# EAGLE design A6ECU-5 (EAGLE 7.5.0)
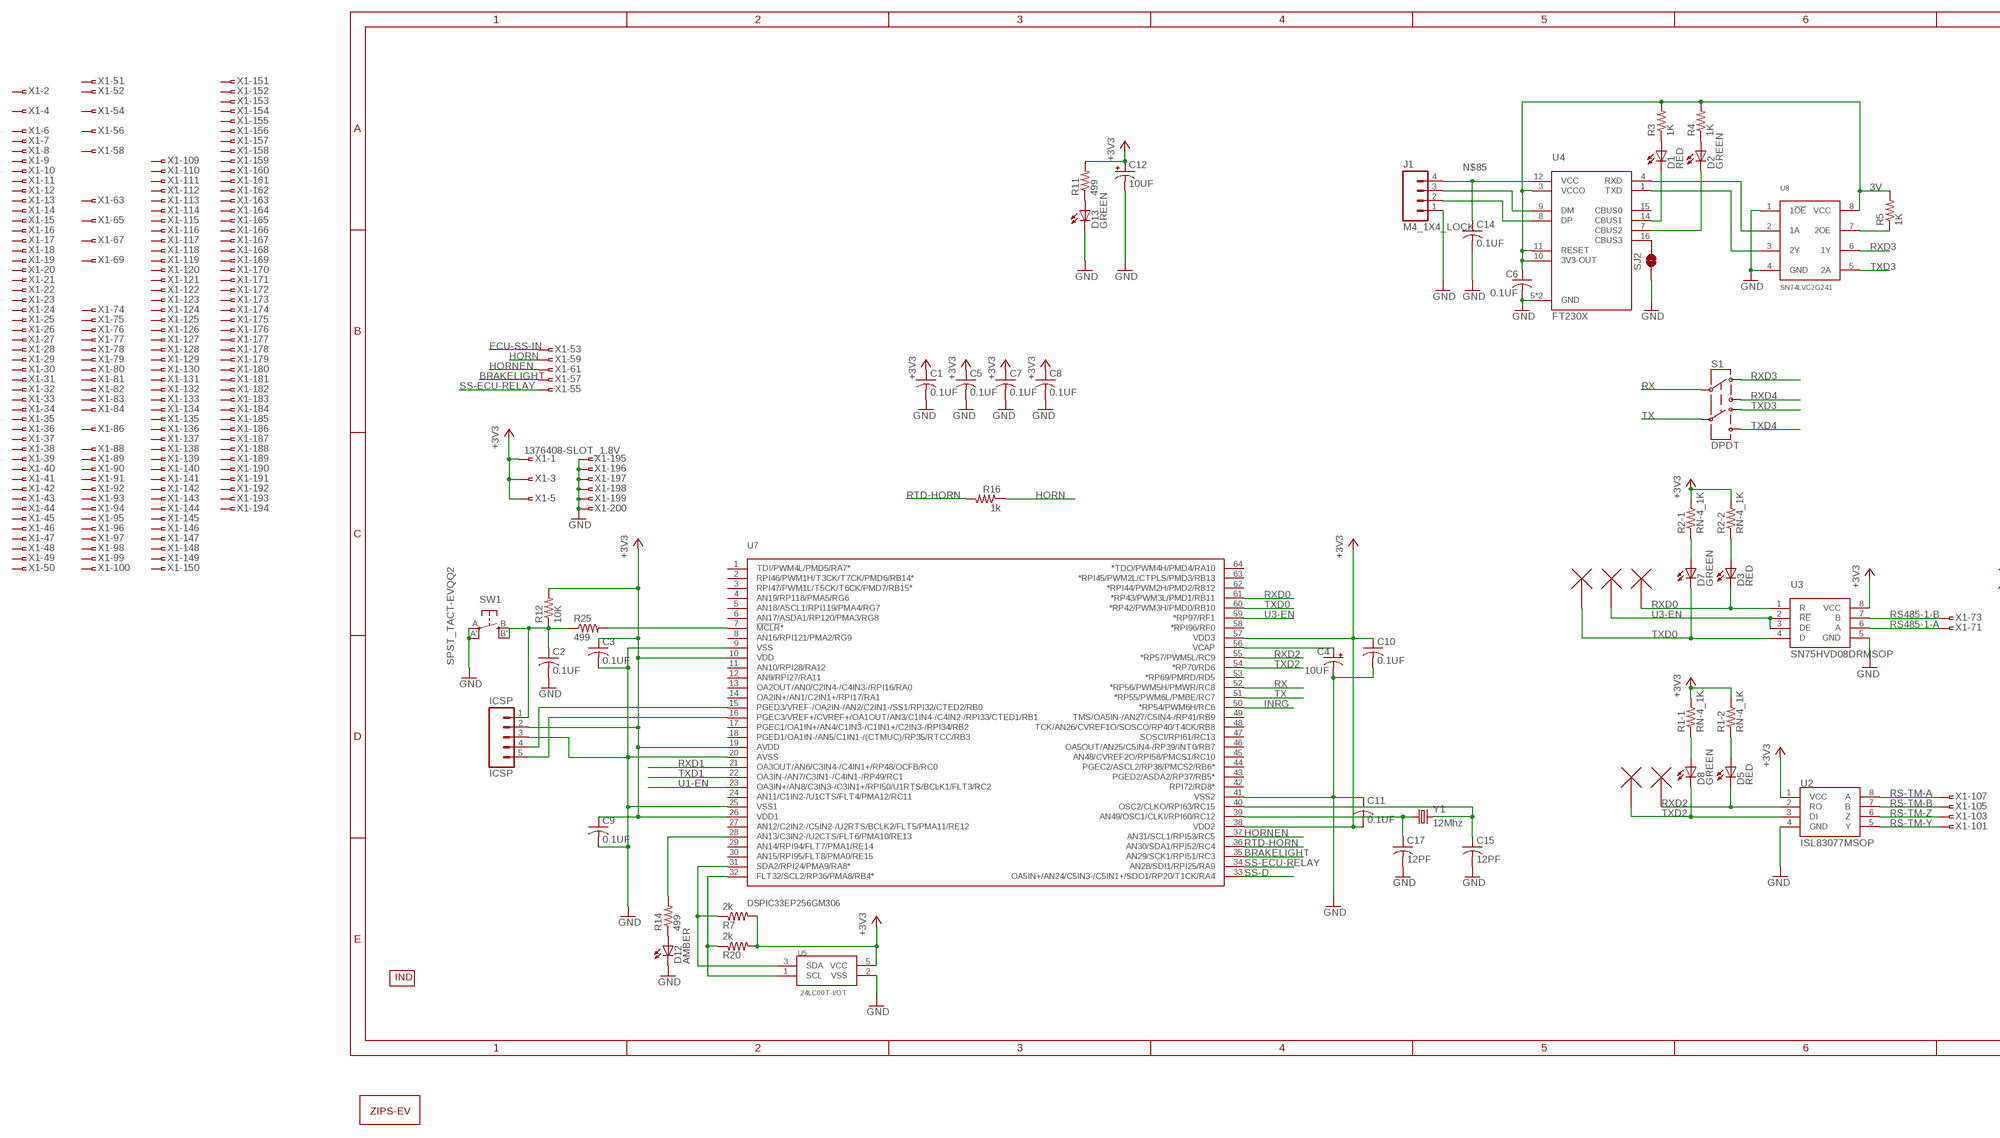
[diagram p0: schematic, sheet 1, part 1 of 2]
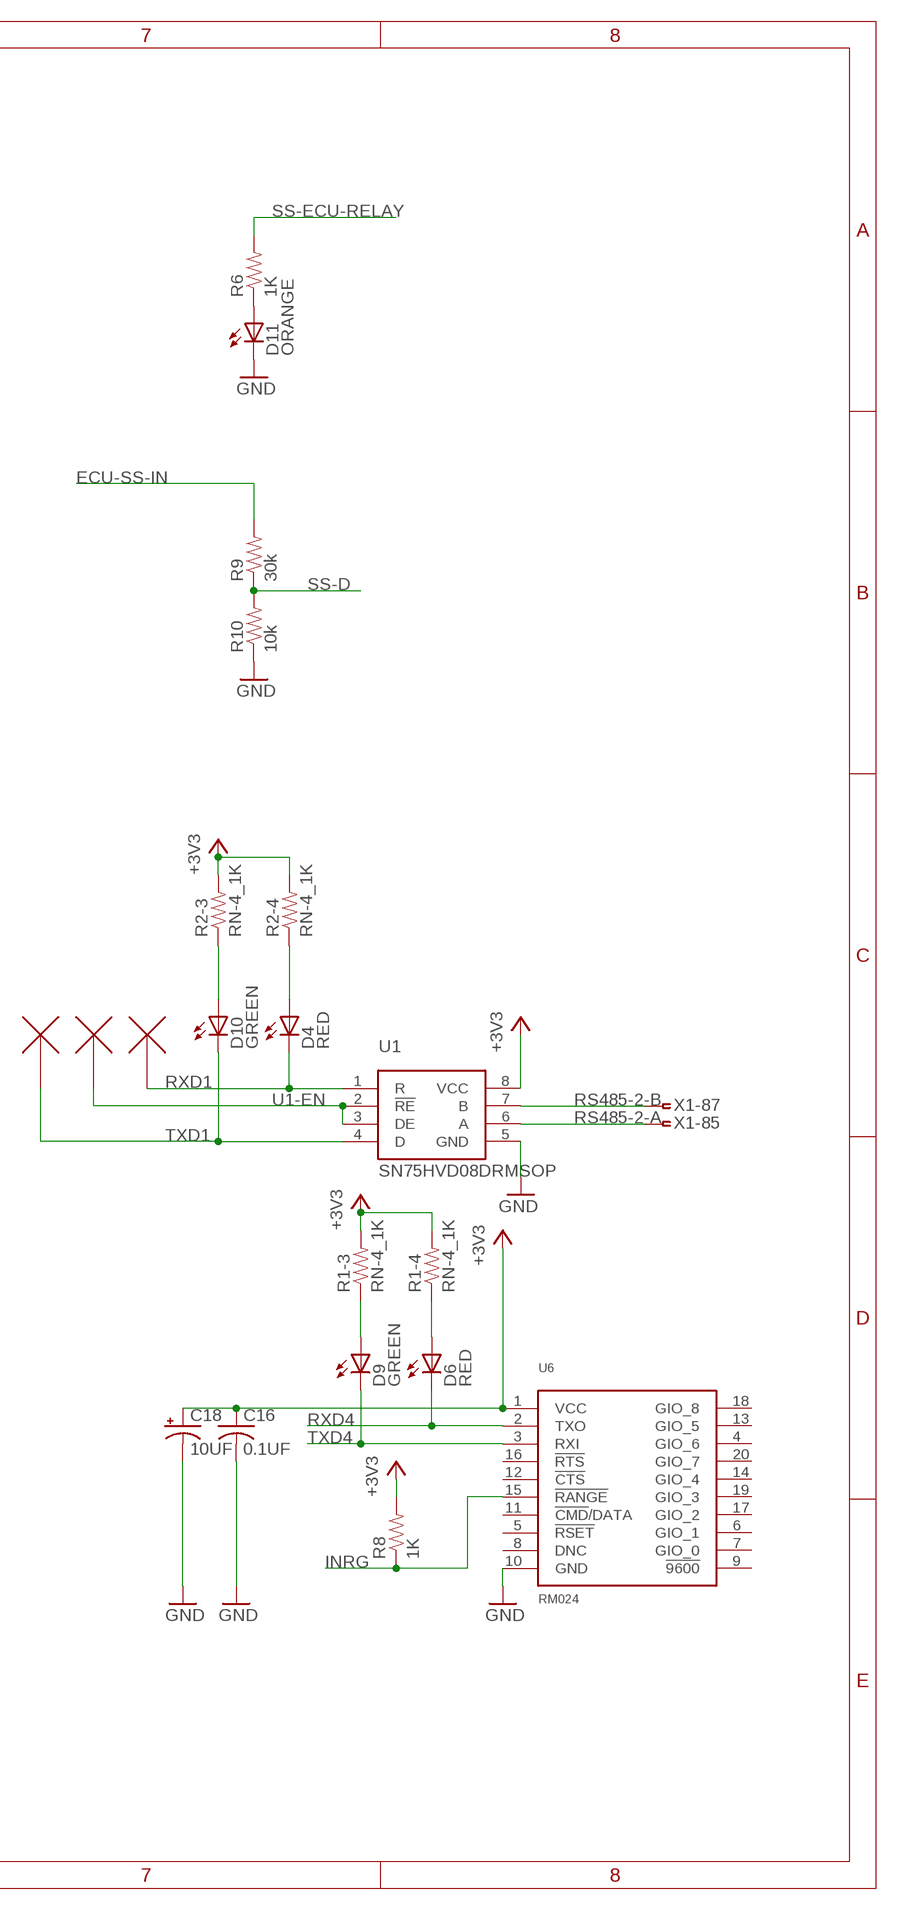
[diagram p1: schematic, sheet 1, part 2 of 2]

## Parts
C1  0.1UF  CAP_0.1UF_50V  [0603]
C2  0.1UF  CAP_0.1UF_50V  [0603]
C3  0.1UF  CAP_0.1UF_50V  [0603]
C4  10UF  CAP-POL_10UF_16V  [EIA3216-16V]
C5  0.1UF  CAP_0.1UF_50V  [0603]
C6  0.1UF  CAP_0.1UF_50V  [0603]
C7  0.1UF  CAP_0.1UF_50V  [0603]
C8  0.1UF  CAP_0.1UF_50V  [0603]
C9  0.1UF  CAP_0.1UF_50V  [0603]
C10  0.1UF  CAP_0.1UF_50V  [0603]
C11  0.1UF  CAP_0.1UF_50V  [0603]
C12  10UF  CAP-POL_10UF_16V  [EIA3216-16V]
C14  0.1UF  CAP_0.1UF_50V  [0603]
C15  12PF  CAP_12PF_50V_0805  [0805]
C16  0.1UF  CAP_0.1UF_50V  [0603]
C17  12PF  CAP_12PF_50V_0805  [0805]
C18  10UF  CAP-POL_10UF_16V  [EIA3216-16V]
D1  RED  LED_RED  [CHIP_LED0805]
D2  GREEN  LED_GREEN  [CHIP_LED0805]
D3  RED  LED_RED  [CHIP_LED0805]
D4  RED  LED_RED  [CHIP_LED0805]
D5  RED  LED_RED  [CHIP_LED0805]
D6  RED  LED_RED  [CHIP_LED0805]
D7  GREEN  LED_GREEN  [CHIP_LED0805]
D8  GREEN  LED_GREEN  [CHIP_LED0805]
D9  GREEN  LED_GREEN  [CHIP_LED0805]
D10  GREEN  LED_GREEN  [CHIP_LED0805]
D11  ORANGE  LED_ORANGE  [CHIP_LED0805]
D12  AMBER  LED_AMBER  [CHIP_LED0805]
D13  GREEN  LED_GREEN  [CHIP_LED0805]
FC  TESTPOINT  [R0603]
FC2  TESTPOINT  [R0603]
ICSP  ICSP  M05LOCK_LONGPADS  [1X05_LOCK_LONGPADS]
J1  M4_1X4_LOCK  [MOLEX_1X4]
R1  RN-4_1K  [MNR14]
R2  RN-4_1K  [MNR14]
R3  1K  RES_1K_5%  [0603]
R4  1K  RES_1K_5%  [0603]
R5  1K  RES_1K_5%  [0603]
R6  1K  RES_1K_5%  [0603]
R7  2k  RES_2K_1%  [0603]
R8  1K  RES_1K_5%  [0603]
R9  30k  RES_30K_1%  [0603]
R10  10k  RES_10K_1%  [0603]
R11  499  RES_499_1%  [0603]
R12  10K  RES_10K_1%  [0603]
R14  499  RES_499_1%  [0603]
R16  1k  RES_1K_5%  [0603]
R20  2k  RES_2K_1%  [0603]
R25  499  RES_499_1%  [0603]
RX0  TESTPOINT  [R0603]
RX1  TESTPOINT  [R0603]
RX2  TESTPOINT  [R0603]
S1  DPDT  SWITCH-DPDTAYZ0202  [AYZ0202]
SJ2  JUMPER-PAD-2-NOYES_SILK  [PAD-JUMPER-2-NO_YES_SILK]
SW1  SPST_TACT-EVQQ2  [EVQ-Q2]
TX0  TESTPOINT  [R0603]
TX1  TESTPOINT  [R0603]
TX2  TESTPOINT  [R0603]
U1  SN75HVD08DRMSOP  [MSOP-8]
U2  ISL83077MSOP  [MSOP8]
U3  SN75HVD08DRMSOP  [MSOP-8]
U4  FT230X  [SSOP-16]
U5  24LC00T-I/OT  [SOT23-5]
U6  RM024  [RM024-TH]
U7  DSPIC33EP256GM306  [TQFP-64]
U8  SN74LVC2G241  [VFSOP-8]
U$1  INDPK1  [PICKIT-PIN-1]
U$2  LOGO16-2-M  [2016-2-LOGO-M]
X1  1376408-SLOT_1.8V  [SLOT-1376408-1_1.8V]
Y1  12Mhz  CRYSTAL5X3  [CRYSTAL-SMD-5X3]

## Nets
3V: C6.1(+) R3.2 R4.2 R5.2 U4.3(VCCO) U4.10(3V3-OUT) U4.11(RESET) U8.8(VCC)
+3V3: C1.1(+) C3.1(+) C5.1(+) C7.1(+) C8.1(+) C9.1(+) C10.1(+) C11.2(-) C12.A(+) C16.1(+) C18.A(+) ICSP.2 R1.5 R1.6 R1.7 R1.8 R2.5 R2.6 R2.7 R2.8 R7.2 R8.2 R11.2 R12.2 R20.2 U1.8(VCC) U2.1(VCC) U3.8(VCC) U5.5(VCC) U6.1(VCC) U7.10(VDD) U7.19(AVDD) U7.26(VDD1) U7.38(VDD2) U7.57(VDD3) X1.1 X1.3 X1.5
BRAKELIGHT: U7.35(AN29/SCK1/RPI51/RC3) X1.57
ECU-SS-IN: R9.2 X1.53
GND: C1.2(-) C2.2(-) C3.2(-) C4.C(-) C5.2(-) C6.2(-) C7.2(-) C8.2(-) C9.2(-) C10.2(-) C11.1(+) C12.C(-) C14.2(-) C15.2(-) C16.2(-) C17.2(-) C18.C(-) D11.C D12.C D13.C ICSP.3 J1.1 R10.1 SJ2.1 SW1.A'(P1) SW1.A(P) U1.5(GND) U2.4(GND) U3.5(GND) U4.5(GND) U4.13(GND) U5.2(VSS) U6.10(GND) U7.9(VSS) U7.20(AVSS) U7.25(VSS1) U7.41(VSS2) U8.1(1!OE) U8.4(GND) X1.195 X1.196 X1.197 X1.198 X1.199 X1.200
HORN: R16.1 X1.59
HORNEN: U7.37(AN31/SCL1/RPI53/RC5) X1.61
INRG: R8.1 U6.15(!RANGE) U7.50(*RP54/PWM6H/RC6)
N$1: D7.A R2.1
N$2: R14.2 U7.28(AN13/C3IN2-/U2CTS/FLT6/PMA10/RE13)
N$3: D13.A R11.1
N$4: D2.A R4.1
N$5: D3.A R2.2
N$6: D4.A R2.4
N$7: D10.A R2.3
N$8: D8.A R1.1
N$9: D5.A R1.2
N$10: D6.A R1.4
N$11: D9.A R1.3
N$12: D11.A R6.1
N$13: C15.1(+) U7.40(OSC2/CLKO/RPI63/RC15) Y1.3
N$14: C17.1(+) U7.39(AN49/OSC1/CLKI/RPI60/RC12) Y1.1
N$15: D12.A R14.1
N$16: R7.1 U5.3(SDA) U7.31(SDA2/RPI24/PMA9/RA8*)
N$17: SJ2.2 U4.16(CBUS3)
N$18: D1.A R3.1
N$19: D2.C U4.7(CBUS2)
N$20: D1.C U4.14(CBUS1)
N$21: U4.4(RXD) U8.2(1A)
N$22: C2.1(+) ICSP.1 R12.1 R25.1 SW1.B'(S1) SW1.B(S)
N$27: U4.1(TXD) U8.3(2Y)
N$28: J1.3 U4.9(DM)
N$32: R20.1 U5.1(SCL) U7.32(FLT32/SCL2/RP36/PMA8/RB4*)
N$54: J1.2 U4.8(DP)
N$69: R5.1 U8.7(2OE)
N$85: C14.1(+) J1.4 U4.12(VCC)
N$87: R25.2 U7.7(!MCLR!*)
N$88: C4.A(+) U7.56(VCAP)
N$90: ICSP.4 U7.15(PGED3/VREF-/OA2IN-/AN2/C2IN1-/SS1/RPI32/CTED2/RB0)
N$91: ICSP.5 U7.16(PGEC3/VREF+/CVREF+/OA1OUT/AN3/C1IN4-/C4IN2-/RPI33/CTED1/RB1)
RS485-1-A: U3.6(A) X1.71
RS485-1-B: U3.7(B) X1.73
RS485-2-A: U1.6(A) X1.85
RS485-2-B: U1.7(B) X1.87
RS-TM-A: U2.8(A) X1.107
RS-TM-B: U2.7(B) X1.105
RS-TM-Y: U2.5(Y) X1.101
RS-TM-Z: U2.6(Z) X1.103
RTD-HORN: R16.2 U7.36(AN30/SDA1/RPI52/RC4)
RX: S1.2 U7.52(*RP56/PWM5H/PMWR/RC8)
RXD0: D3.C RX0.1 RX0.2 U3.1(R) U7.61(*RP43/PWM3L/PMD1/RB11)
RXD1: D4.C RX1.1 RX1.2 U1.1(R) U7.21(OA3OUT/AN6/C3IN4-/C4IN1+/RP48/OCFB/RC0)
RXD2: D5.C RX2.1 RX2.2 U2.2(RO) U7.55(*RP57/PWM5L/RC9)
RXD3: S1.1 U8.6(1Y)
RXD4: D6.C S1.3 U6.2(TXO)
SS-D: R9.1 R10.2 U7.33(OA5IN+/AN24/C5IN3-/C5IN1+/SDO1/RP20/T1CK/RA4)
SS-ECU-RELAY: R6.2 U7.34(AN28/SDI1/RPI25/RA9) X1.55
TX: S1.5 U7.51(*RP55/PWM6L/PMBE/RC7)
TXD0: D7.C TX0.1 TX0.2 U3.4(D) U7.60(*RP42/PWM3H/PMD0/RB10)
TXD1: D10.C TX1.1 TX1.2 U1.4(D) U7.22(OA3IN-/AN7/C3IN1-/C4IN1-/RP49/RC1)
TXD2: D8.C TX2.1 TX2.2 U2.3(DI) U7.54(*RP70/RD6)
TXD3: S1.4 U8.5(2A)
TXD4: D9.C S1.6 U6.3(RXI)
U1-EN: FC.1 FC.2 U1.2(!RE) U1.3(DE) U7.23(OA3IN+/AN8/C3IN3-/C3IN1+/RPI50/U1RTS/BCLK1/FLT3/RC2)
U3-EN: FC2.1 FC2.2 U3.2(!RE) U3.3(DE) U7.59(*RP97/RF1)
Unconnected: U4.15(CBUS0) U6.4(GIO_6) U6.5(!RSET) U6.6(GIO_1) U6.7(GIO_0) U6.8(DNC) U6.9(!9600) U6.11(!CMD!/DATA) U6.12(!CTS) U6.13(GIO_5) U6.14(GIO_4) U6.16(!RTS) U6.17(GIO_2) U6.18(GIO_8) U6.19(GIO_3) U6.20(GIO_7) U7.1(TDI/PWM4L/PMD5/RA7*) U7.2(RPI46/PWM1H/T3CK/T7CK/PMD6/RB14*) U7.3(RPI47/PWM1L/T5CK/T6CK/PMD7/RB15*) U7.4(AN19/RP118/PMA5/RG6) U7.5(AN18/ASCL1/RPI119/PMA4/RG7) U7.6(AN17/ASDA1/RP120/PMA3/RG8) U7.8(AN16/RPI121/PMA2/RG9) U7.11(AN10/RPI28/RA12) U7.12(AN9/RPI27/RA11) U7.13(OA2OUT/AN0/C2IN4-/C4IN3-/RPI16/RA0) U7.14(OA2IN+/AN1/C2IN1+/RPI17/RA1) U7.17(PGEC1/OA1IN+/AN4/C1IN3-/C1IN1+/C2IN3-/RPI34/RB2) U7.18(PGED1/OA1IN-/AN5/C1IN1-/(CTMUC)/RP35/RTCC/RB3) U7.24(AN11/C1IN2-/U1CTS/FLT4/PMA12/RC11) U7.27(AN12/C2IN2-/C5IN2-/U2RTS/BCLK2/FLT5/PMA11/RE12) U7.29(AN14/RPI94/FLT7/PMA1/RE14) U7.30(AN15/RPI95/FLT8/PMA0/RE15) U7.42(RPI72/RD8*) U7.43(PGED2/ASDA2/RP37/RB5*) U7.44(PGEC2/ASCL2/RP38/PMCS2/RB6*) U7.45(AN48/CVREF2O/RPI58/PMCS1/RC10) U7.46(OA5OUT/AN25/C5IN4-/RP39/INT0/RB7) U7.47(SOSCI/RPI61/RC13) U7.48(TCK/AN26/CVREF1O/SOSCO/RP40/T4CK/RB8) U7.49(TMS/OA5IN-/AN27/C5IN4-/RP41/RB9) U7.53(*RP69/PMRD/RD5) U7.58(*RPI96/RF0) U7.62(*RPI44/PWM2H/PMD2/RB12) U7.63(*RPI45/PWM2L/CTPLS/PMD3/RB13) U7.64(*TDO/PWM4H/PMD4/RA10) X1.2 X1.4 X1.6 X1.7 X1.8 X1.9 X1.10 X1.11 X1.12 X1.13 X1.14 X1.15 X1.16 X1.17 X1.18 X1.19 X1.20 X1.21 X1.22 X1.23 X1.24 X1.25 X1.26 X1.27 X1.28 X1.29 X1.30 X1.31 X1.32 X1.33 X1.34 X1.35 X1.36 X1.37 X1.38 X1.39 X1.40 X1.41 X1.42 X1.43 X1.44 X1.45 X1.46 X1.47 X1.48 X1.49 X1.50 X1.51 X1.52 X1.54 X1.56 X1.58 X1.60 X1.62 X1.63 X1.64 X1.65 X1.66 X1.67 X1.68 X1.69 X1.70 X1.72 X1.74 X1.75 X1.76 X1.77 X1.78 X1.79 X1.80 X1.81 X1.82 X1.83 X1.84 X1.86 X1.88 X1.89 X1.90 X1.91 X1.92 X1.93 X1.94 X1.95 X1.96 X1.97 X1.98 X1.99 X1.100 X1.102 X1.104 X1.106 X1.108 X1.109 X1.110 X1.111 X1.112 X1.113 X1.114 X1.115 X1.116 X1.117 X1.118 X1.119 X1.120 X1.121 X1.122 X1.123 X1.124 X1.125 X1.126 X1.127 X1.128 X1.129 X1.130 X1.131 X1.132 X1.133 X1.134 X1.135 X1.136 X1.137 X1.138 X1.139 X1.140 X1.141 X1.142 X1.143 X1.144 X1.145 X1.146 X1.147 X1.148 X1.149 X1.150 X1.151 X1.152 X1.153 X1.154 X1.155 X1.156 X1.157 X1.158 X1.159 X1.160 X1.161 X1.162 X1.163 X1.164 X1.165 X1.166 X1.167 X1.168 X1.169 X1.170 X1.171 X1.172 X1.173 X1.174 X1.175 X1.176 X1.177 X1.178 X1.179 X1.180 X1.181 X1.182 X1.183 X1.184 X1.185 X1.186 X1.187 X1.188 X1.189 X1.190 X1.191 X1.192 X1.193 X1.194

## Library data of the parts
C1-C3 C5-C11 C14 C16 = FSAE Electric:CAP; PARTNO: CC0603ZRY5V9BB104
C4 C12 C18 = FSAE Electric:CAP-POL; PARTNO: T491A106M016AT
C15 C17 = FSAE Electric:CAP; PARTNO: CL21C120JBANNNC
D1 D3-D6 = FSAE Electric:LED; PARTNO: LH R974-LP-1
D2 D7-D10 D13 = FSAE Electric:LED; PARTNO: LTST-S220GKT
D11 = FSAE Electric:LED; PARTNO: LTST-C170KFKT
D12 = FSAE Electric:LED; PARTNO: HSMA-C170
FC FC2 RX0 RX1 RX2 TX1 TX2 = DFT2:TESTPOINT
ICSP = SparkFun-Connectors:M05: Header 5 Standard 5-pin 0.1" header. Use with straight break away headers (SKU : PRT-00116), right angle break away headers (PRT-00553), swiss pins (PRT-00743), machine pins (PRT-00117), and female headers (PRT-00115). Molex polarized connector foot print use with SKU : PRT-08230 with associated crimp pins and housings.
J1 = FSAE Electric:M4: Molex 1x4 Connectors; PARTNO: 0022232041
R1 R2 = FSAE Eletric:RN-4; PARTNO: MNR14ERAPJ102
R3-R6 R8 = FSAE Electric:RES: Resistors; PARTNO: RC0603JR-071KL
R7 R20 = FSAE Eletric:RES; PARTNO: ERJ-3EKF2001V
R9 = FSAE Eletric:RES; PARTNO: RC0603FR-0730KL
R10 = FSAE Eletric:RES; PARTNO: RC0603FR-0710KL
R11 R14 R25 = FSAE Eletric:RES; PARTNO: RC0603FR-07499RL
R12 = FSAE Electric:RES: Resistors; PARTNO: RC0603FR-0710KL
R16 = FSAE Eletric:RES; PARTNO: RC0603JR-071KL
S1 = SparkFun-Electromechanical:SWITCH-DPDT: DPDT Version of the COM-00597; PARTNO: AYZ0202AGRLC; PROD_ID: SWCH-08179
SJ2 = SparkFun-Passives:JUMPER-PAD-2-NO
SW1 = adafruit:SPST_TACT: SMT 6mm switch, EVQQ2 series http://www.ladyada.net/library/eagle; PARTNO: EVQ-Q2F03W
TX0 = DFT2:TESTPOINT; PARTNO: 1625854-3
U1 U3 = FSAE Electric:SN75HVD08DR: RS485 Transceiver View on DigiKey <http://www.digikey.com/product-detail/en/SN75HVD08DR/296-37893-1-ND/4899996>; PARTNO: ISL83072EIUZA-T
U2 = NASA_LIB:ISL83077; PARTNO: ISL83072EIUZA-T
U4 = FSAE Electric:FT230X; PARTNO: FT230XS-R
U5 = FSAE Eletric:24LC00T-I/OT; PARTNO: 24LC00T-I/OT
U6 = FSAE Eletric:RM024
U7 = FSAE Electric:DSPIC33EP256GM306; PARTNO: DSPIC33EP256GM306-I/PT
U8 = FSAE Electric:SN74LVC2G241; PARTNO: SN74LVC2G241DCUR
U$1 = FSAE Eletric:IND
U$2 = Pic:LOGO
X1 = con-amp:1376408: DDR1 & DDR2 SODIMM SOCKET 0.6mm Pitch 200 Pos. Standard Profile, Standard Type (used on Kontron X-Board) Source: http://catalog.tycoelectronics.com .. JPN_CD_1376408_S.pdf
Y1 = SparkFun-FreqCtrl:CRYSTAL: Various standard crystals. Proven footprints. Spark Fun Electronics SKU : COM-00534

## Board
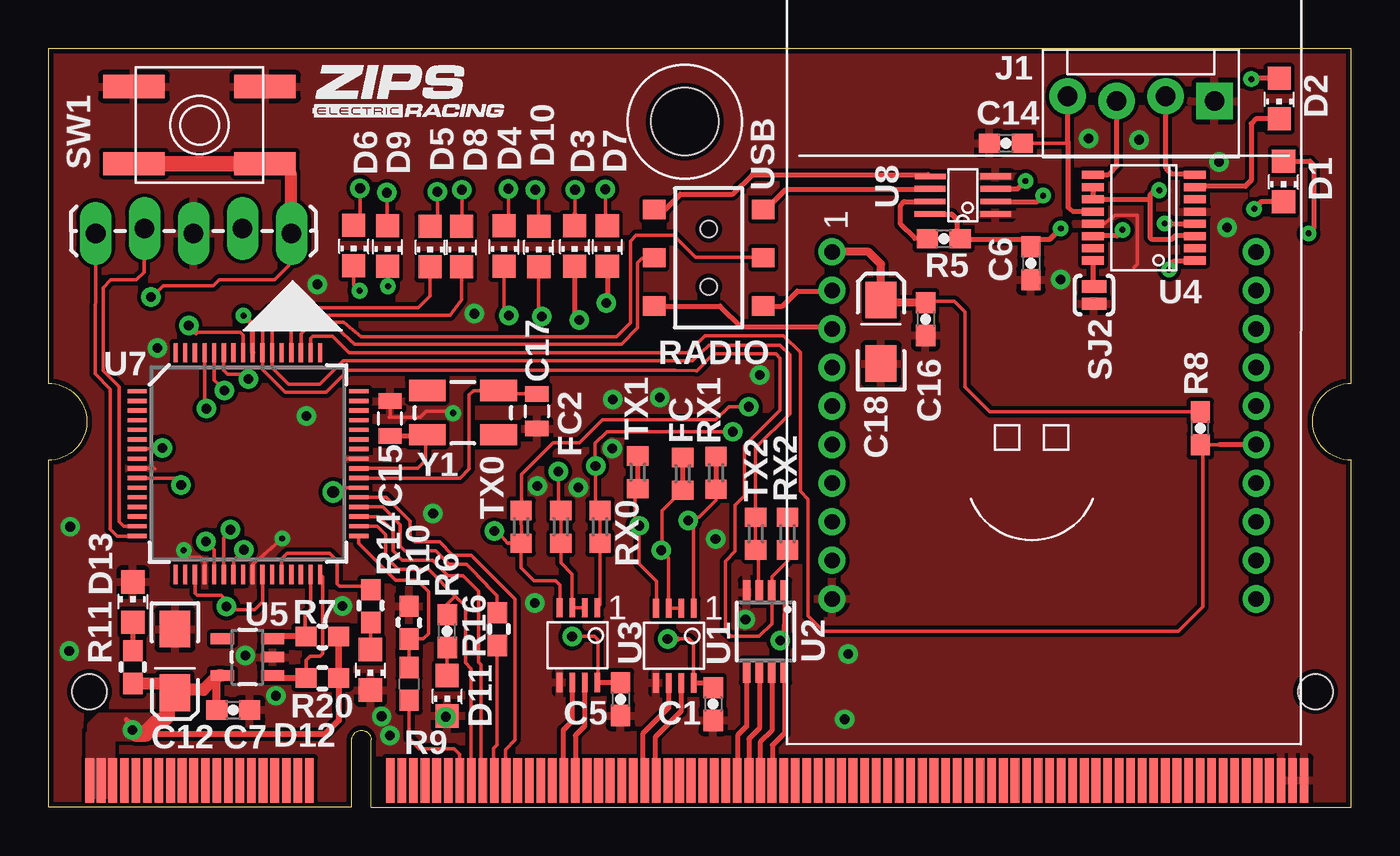
[diagram p2: board, top side]
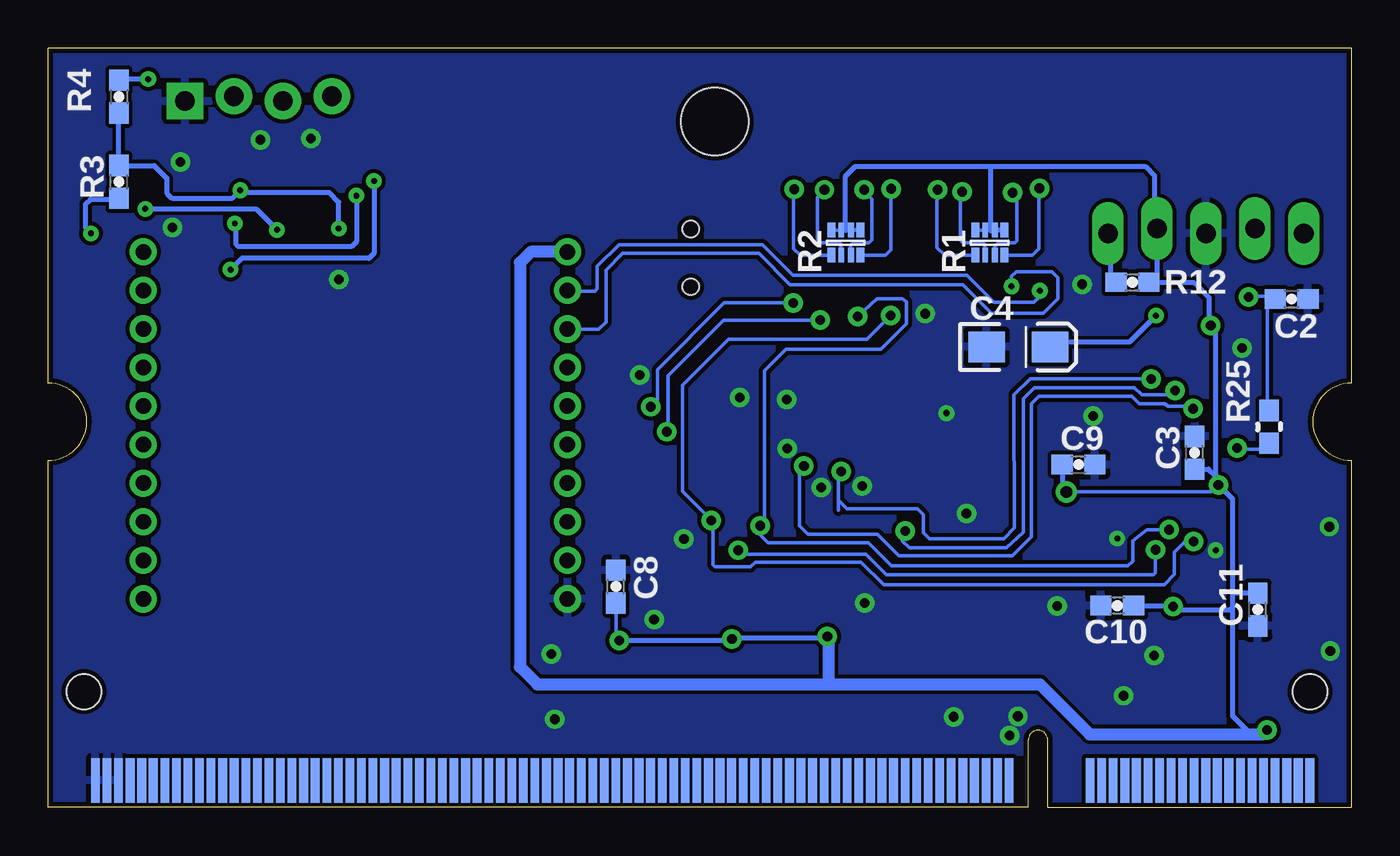
[diagram p3: board, bottom side, seen from below]

Size 67.6 x 39.37 mm. Coordinates in mm from the lower left corner, seen from the top.
Copper layers (1*16): Top 0.035mm / dielectric 1.5mm / Bottom 0.035mm
Design rules "SparkFun": minimum track width 8mil, minimum drill 20mil, track to track 8mil, track to pad 8mil, pad to pad 8mil, via to via 8mil, smd to smd 8mil, copper to edge 10mil, drill to drill 8mil, minimum pad ring 12mil, minimum via ring 10mil, stop-mask expansion 4mil, vias tented up to drill 25mil, thermal gap 10mil
